# EasyEDA Pro project YanQi_Project_V2.0.eprj, schematic BatteryBoard
Create Date: 2023-08-09; Page Name: P1; Project Name: YanXi_Project; Schematic Name: BatteryBoard; Update Date: 2023-08-09; Company: 嘉立创EDA; Page Size: A4; Version: V1.0
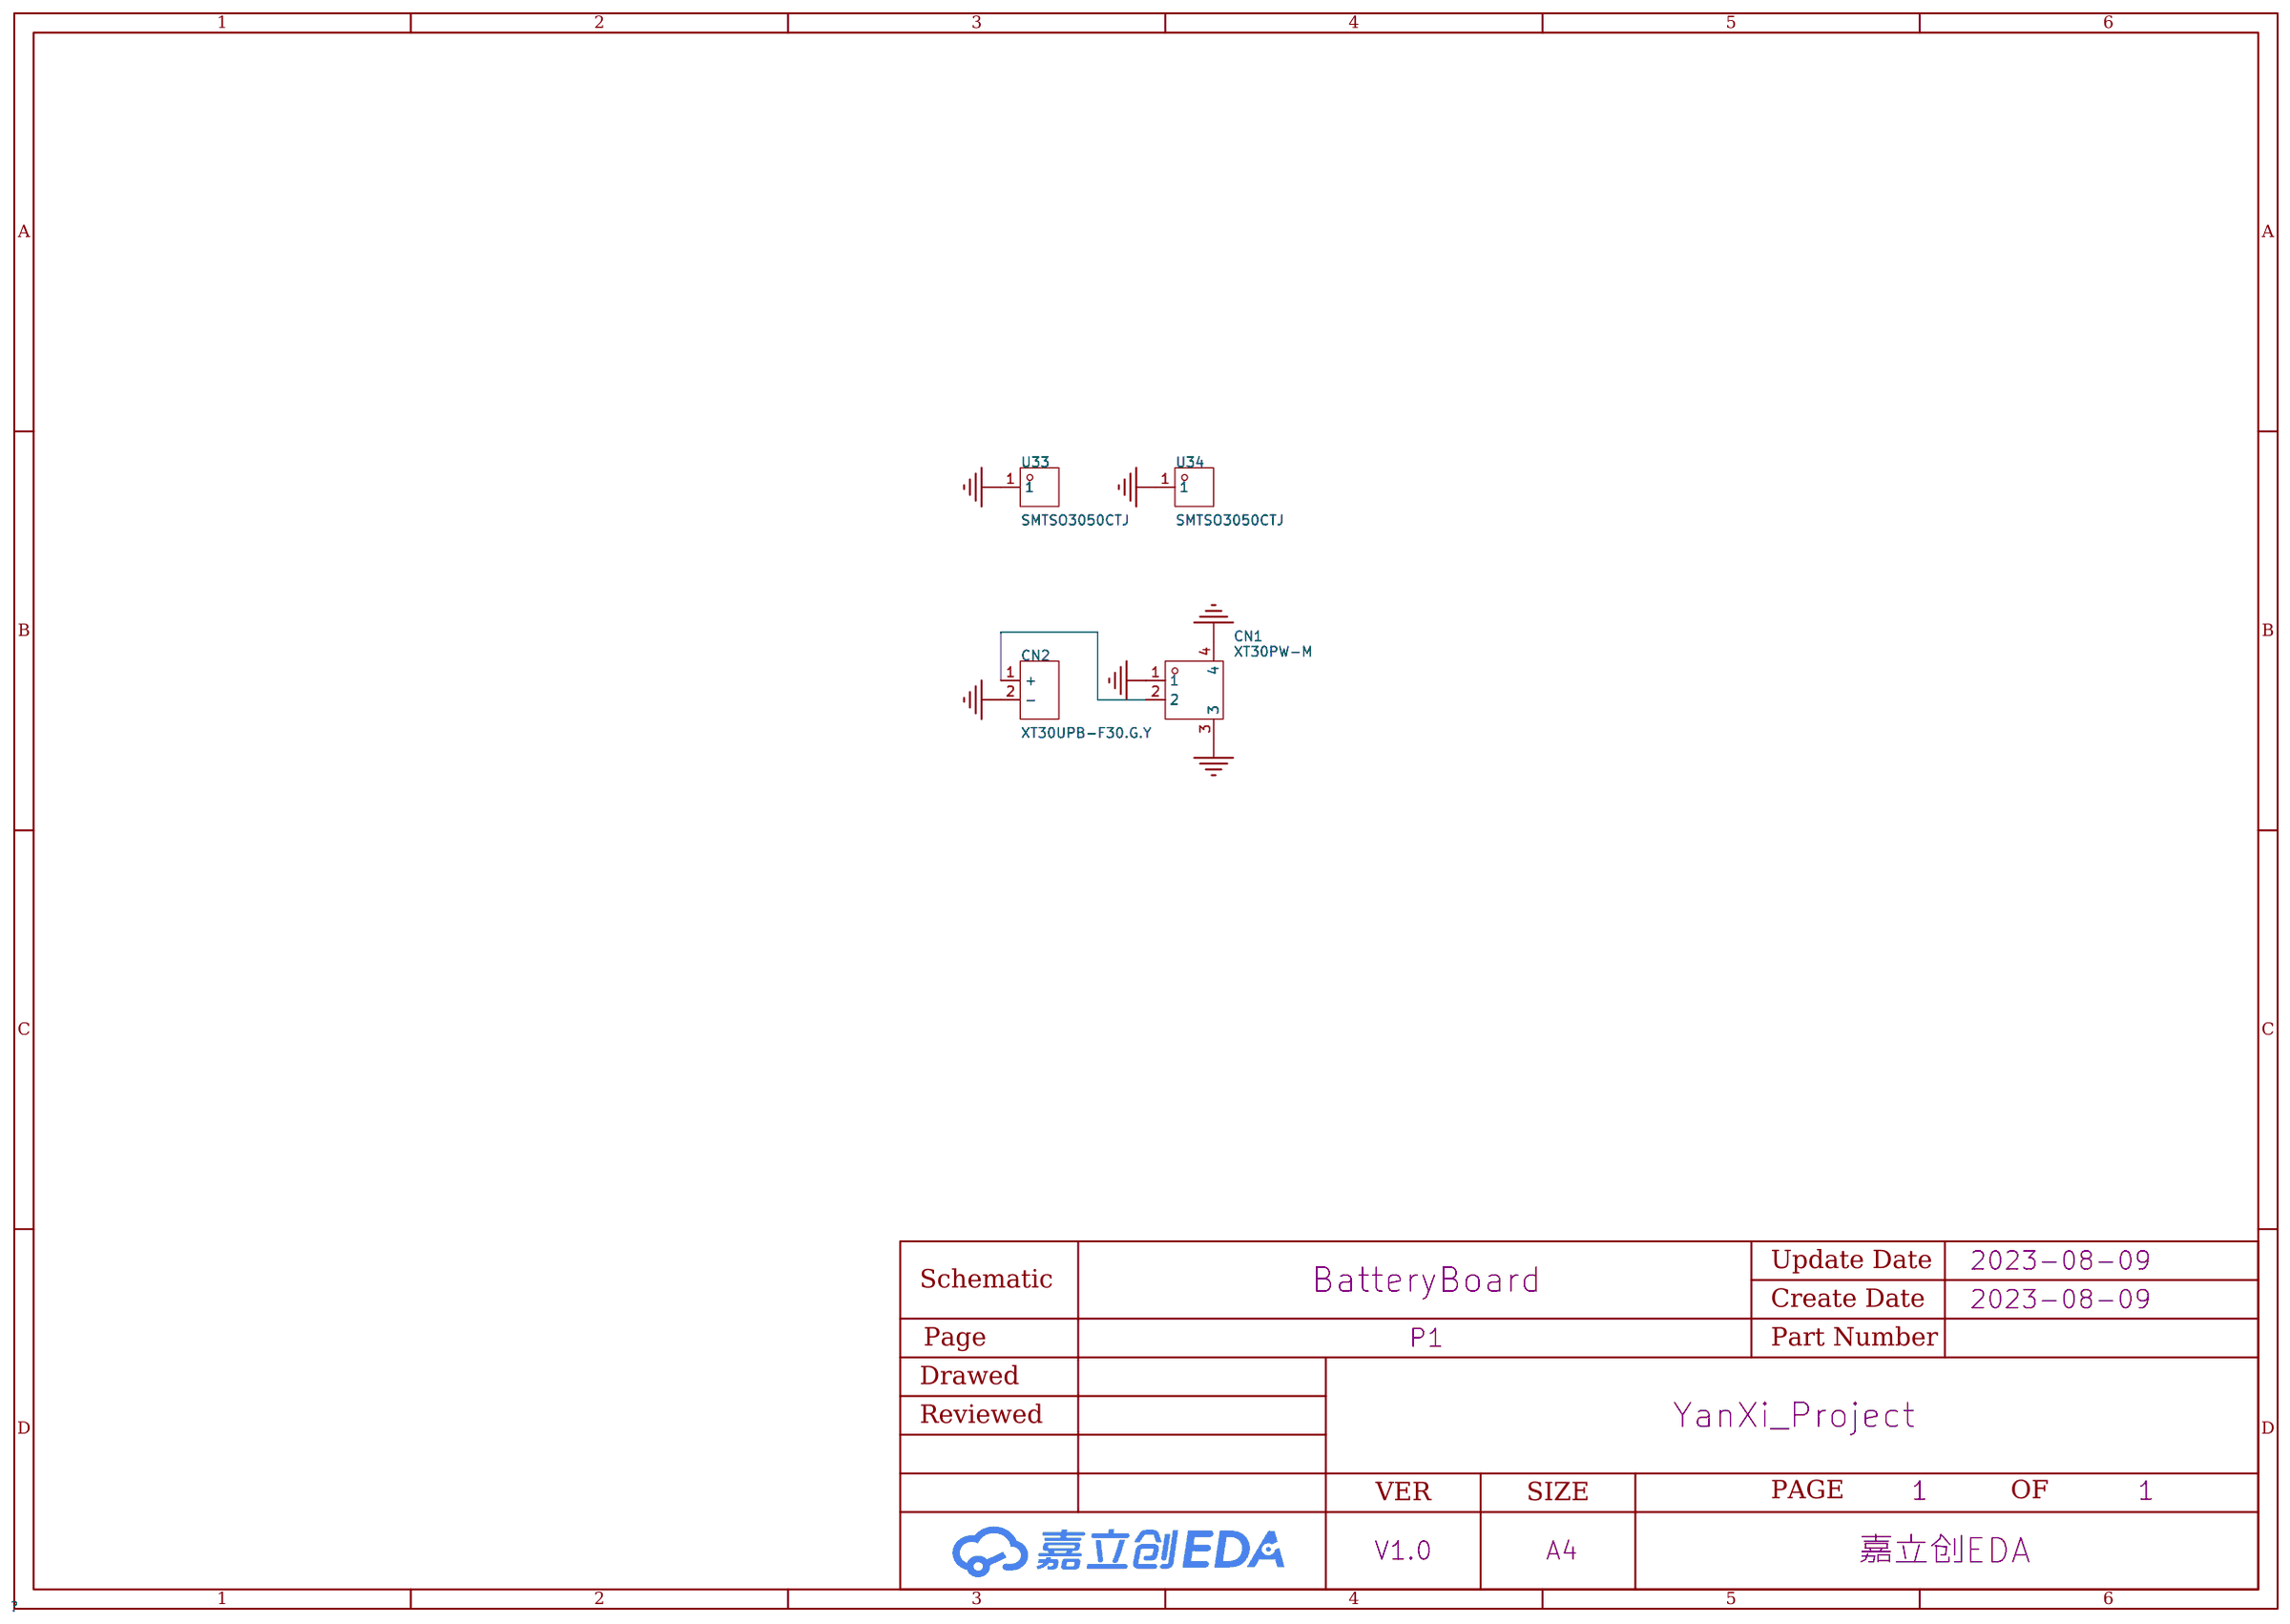
[diagram p5: schematic sheet]

## Parts
CN1  XT30PW-M  [CONN-TH_XT30PW-M]
CN2  XT30UPB-F30.G.Y  [CONN-TH_XT30UPB-F]
U33  SMTSO3050CTJ  [SMD_SMTSO3060CTJ]
U34  SMTSO3050CTJ  [SMD_SMTSO3060CTJ]

## Library data of the parts
CN1 = XT30PW-M: Socket,DCsupply,XT30,male,PIN:2; LCSC Part Name: AMASS(艾迈斯)航模插头 卧式弯脚 XT30PW-M公头; Supplier Part: C431092; Manufacturer: AMASS(艾迈斯); JLCPCB Part Class: 扩展库; Datasheet: https://atta.szlcsc.com/upload/public/pdf/source/20220222/6A9F22F7850E25B33E1BE430ADF8560B.pdf; Supplier: LCSC
CN2 = XT30UPB-F30.G.Y: 模型插头连接器; LCSC Part Name: AMASS(艾迈斯)直立焊板式连接器XT30UPB30-F.G.*; Supplier Part: C108769; Manufacturer: AMASS(艾迈斯); JLCPCB Part Class: Extended Part; Datasheet: https://atta.szlcsc.com/upload/public/pdf/source/20220715/AFD68B9E8B6CA95A7295DBF4AF9325E4.pdf; Supplier: LCSC
U33 U34 = SMTSO3050CTJ: M3x5.56xL5+1.53; LCSC Part Name: 雄和远景，电路板表贴圆螺母柱，M3X5，铜镀锡; Supplier Part: C2915636; Manufacturer: Sinhoo(雄和远景); JLCPCB Part Class: Extended Part; Datasheet: https://atta.szlcsc.com/upload/public/pdf/source/20211122/17CF5E24EB4D4DC090A80DE3D7DE5E21.pdf; Supplier: LCSC

## Nets
GND: CN1.1 CN1.3 CN1.4 CN2.2(-) U33.1 U34.1
$1N337: CN1.2 CN2.1(+)
